# EasyEDA Pro project BlueberryPi.eprj, board PCB1 (continued)
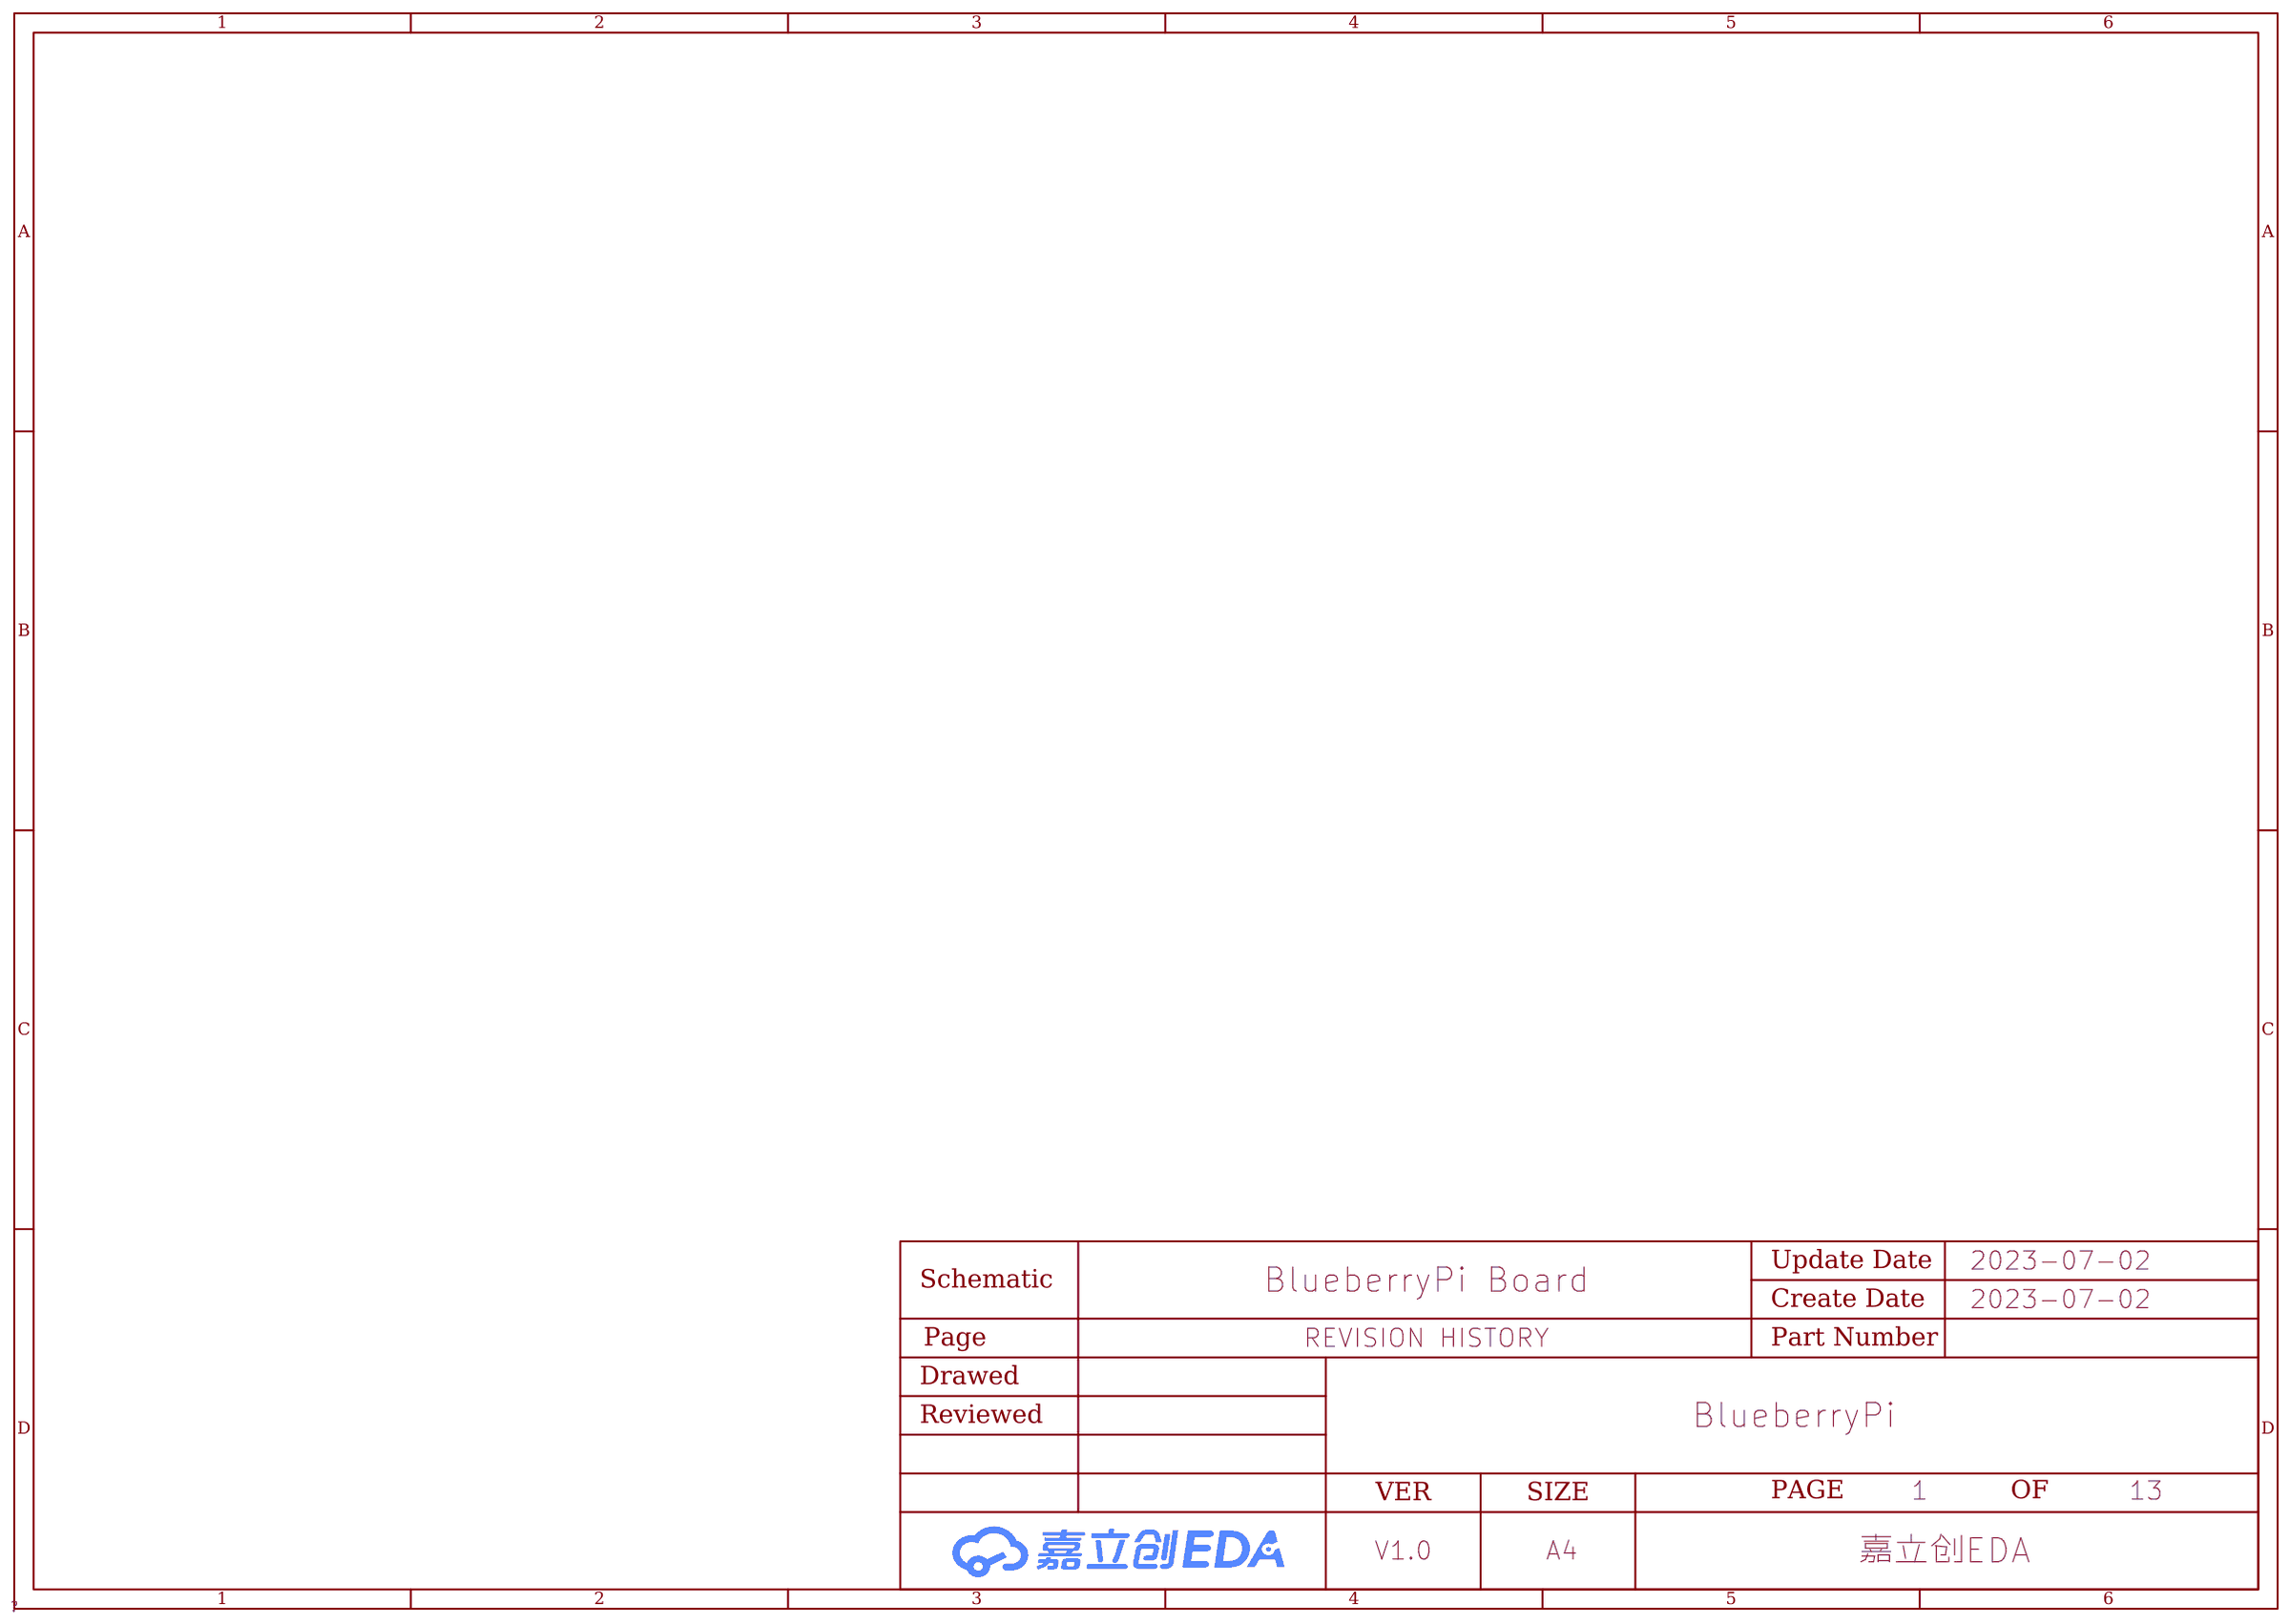
[diagram p0: REVISION HISTORY]
## Routing (per net, layer and track width the routed paths; a pad name or vN(x,y) marks a point on that pad's centre or on a via; arc(x,y) is an arc through that point) (continued)
SCKP: length 36.5
  Top Layer w0.102: v2(49.81,41.58) 49.63,41.76 49.63,42.01 49.86,42.24 49.86,42.67 49.77,42.77 49.62,42.77 49.53,42.67 U1.AC12
  Bottom Layer w0.102: v2(49.81,41.58) 49.81,41.57 49.64,41.4 49.64,40.52 arc(49.55,40.28) 49.31,40.19 49.11,40.19 arc(49.01,40.09) 49.11,39.98 49.31,39.98 arc(49.64,39.65) 49.31,39.32 49,39.32 arc(48.9,39.22) 49,39.12 49.31,39.12 arc(49.64,38.79) 49.31,38.46 49,38.46 arc(48.9,38.36) 49,38.26 49.31,38.26 arc(49.64,37.93) 49.31,37.6 49,37.6 arc(48.9,37.5) 49,37.39 49.31,37.39 arc(49.64,37.06) 49.31,36.73 49,36.73 arc(48.9,36.63) 49,36.53 49.31,36.53 arc(49.64,36.2) 49.31,35.87 49,35.87 arc(48.89,35.77) 49,35.67 49.31,35.67 arc(49.64,35.34) 49.31,35.01 49,35.01 arc(48.9,34.9) 49,34.8 49.31,34.8 arc(49.64,34.47) 49.31,34.14 49,34.14 arc(48.9,34.04) 49,33.94 49.31,33.94 arc(49.64,33.61) 49.31,33.28 49,33.28 arc(48.9,33.18) 49,33.08 49.31,33.08 arc(49.55,32.98) 49.64,32.75 49.64,31.62 arc(49.55,31.38) 49.31,31.29 49.16,31.29 arc(49.06,31.19) 49.16,31.08 49.31,31.08 arc(49.64,30.75) 49.31,30.42 49.16,30.42 arc(49.06,30.32) 49.16,30.22 49.31,30.22 arc(49.64,29.89) 49.31,29.56 49.16,29.56 arc(49.06,29.46) 49.16,29.36 49.31,29.36 arc(49.55,29.26) 49.64,29.03 49.64,28.33 arc(49.55,28.09) 49.31,28 48.02,28 arc(47.92,27.9) 48.02,27.8 49.31,27.8 arc(49.64,27.46) 49.31,27.13 48.91,27.13 arc(48.81,27.03) 48.91,26.93 49.31,26.93 arc(49.55,26.83) 49.64,26.6 49.64,26.33 49.18,25.87 49.18,24.69 49.41,24.45 49.49,24.45 49.56,24.52 v2(49.56,24.74)
SCS0: length 36.7
  Bottom Layer w0.127: v2(50.18,44.98) 50.54,45.34 55.11,45.34 57.49,42.96 57.49,24.86 55.31,22.68 51.19,22.68 50.18,23.69 50.18,24.48 50.49,24.79 v2(50.8,24.79)
SCS1: length 36.6
  Bottom Layer w0.127: v2(50.83,44.33) 50.83,43.56 50.98,43.41 arc(51.01,43.32) 50.98,43.23 49.91,42.16 arc(49.91,41.98) 50.09,41.98 51.16,43.05 arc(51.34,43.05) 51.34,42.87 50.26,41.8 arc(50.26,41.62) 50.44,41.62 51.52,42.69 arc(51.7,42.69) 51.69,42.51 50.62,41.44 arc(50.62,41.26) 50.8,41.26 51.88,42.33 arc(51.96,42.37) 52.05,42.33 52.11,42.28 52.17,42.28 arc(52.26,42.24) 52.3,42.15 52.3,41.08 arc(52.43,40.96) 52.55,41.08 52.55,42.15 arc(52.59,42.24) 52.68,42.28 54.1,42.28 54.39,41.99 54.39,34.15 54.52,34.02 54.52,32.86 54.04,32.37 54.04,28.55 53.52,28.03 51.35,28.03 50.9,27.58 v2(50.9,25.54)
SDC0-CLK: length 7
  Top Layer w0.127: U45.2 18.14,84.7 19.56,83.28 R94.2 ; CARD1.5 17.72,84.7
SDC0-CMD: length 62.1
  Top Layer w0.127: 12.5,83.69 13.42,82.77 17.17,82.77 18.24,81.7 18.24,78.74 19.11,77.86 19.79,77.86 37.68,59.97 37.68,56.74 39.6,54.83 39.6,54.1 41.24,52.46 43.26,52.46 43.58,52.78 U1.G3 ; 12.5,83.69 12.5,79.91 13.08,79.32 ; 12.5,83.69 12.5,87.12 12.88,87.5 15.16,87.5 15.52,87.15 CARD1.3 U43.2
SDC0-D0: length 44.1
  Top Layer w0.127: U1.F3 43.53,53.43 43.19,53.77 41.8,53.77 40.93,54.64 40.93,55.33 38.91,57.35 38.91,60.71 21.15,78.47 21.15,81.99 20.45,82.69 20.45,84.59 20.33,84.7 U47.2 CARD1.7
SDC0-D1: length 42.3
  Top Layer w0.127: U1.E2 42.67,54.44 42.17,54.44 41.89,54.72 41.5,54.72 41.27,54.95 41.27,55.52 39.23,57.56 39.23,60.88 21.54,78.58 21.54,84.6 21.44,84.7 U40.2 CARD1.8
SDC0-D2: length 49.3
  Top Layer w0.127: CARD1.1 U41.2 13.73,84.7 13.87,84.57 13.87,83.79 14.52,83.15 17.45,83.15 18.59,82 18.59,78.87 19.29,78.17 19.95,78.17 37.99,60.13 37.99,56.9 39.93,54.95 39.93,54.25 41.4,52.78 U1.G2
SDC0-D3: length 47.2
  Top Layer w0.127: U1.F1 41.67,53.43 40.6,54.5 40.6,55.21 38.6,57.21 38.6,60.55 20.82,78.33 20.82,78.93 19.98,79.77 19.1,79.77 18.94,79.93 18.94,82.27 17.68,83.53 15.25,83.53 14.97,83.81 14.97,84.56 14.83,84.7 U42.2 CARD1.2
SDC0-DET: length 45.1
  Top Layer w0.127: CARD1.9 U49.2 22.34,84.7 22.63,84.42 22.63,79.83 22.12,79.32 22.12,78.48 39.55,61.05 39.55,57.75 42.22,55.08 46.45,55.08 46.75,55.38 U1.C8
SDQ0: length 16.9
  Top Layer w0.127: U35.P9 52.78,29.49 v2(53.11,29.16) ; U1.AB18 53.11,42.71 53.11,42.04 v2(53.29,41.86)
  Bottom Layer w0.127: v2(53.11,29.16) 53.44,29.49 53.44,33.6 53.72,33.88 53.72,37.07 arc(53.69,37.14) 53.62,37.17 arc(53.54,37.2) 53.51,37.27 53.51,37.32 arc(53.54,37.39) 53.62,37.42 arc(53.69,37.45) 53.72,37.53 53.72,37.57 arc(53.69,37.65) 53.62,37.68 arc(53.54,37.71) 53.51,37.78 53.51,37.83 arc(53.54,37.9) 53.62,37.93 arc(53.69,37.96) 53.72,38.04 53.72,38.08 arc(53.69,38.16) 53.62,38.19 arc(53.54,38.22) 53.51,38.29 53.51,38.34 arc(53.54,38.41) 53.62,38.44 arc(53.69,38.47) 53.72,38.54 53.72,38.59 arc(53.69,38.66) 53.62,38.69 arc(53.54,38.72) 53.51,38.8 53.51,38.84 arc(53.54,38.92) 53.62,38.95 arc(53.69,38.98) 53.72,39.05 53.72,39.1 arc(53.69,39.17) 53.62,39.2 arc(53.54,39.23) 53.51,39.31 53.51,39.35 arc(53.54,39.43) 53.62,39.46 arc(53.69,39.49) 53.72,39.56 53.72,39.61 arc(53.69,39.68) 53.62,39.71 arc(53.54,39.74) 53.51,39.81 53.51,39.86 arc(53.54,39.93) 53.62,39.96 arc(53.69,39.99) 53.72,40.07 53.72,40.11 arc(53.69,40.19) 53.62,40.22 arc(53.54,40.25) 53.51,40.32 53.51,40.37 arc(53.54,40.44) 53.62,40.47 arc(53.69,40.5) 53.72,40.58 53.72,40.62 arc(53.69,40.7) 53.62,40.73 arc(53.54,40.76) 53.51,40.83 53.51,40.88 arc(53.54,40.95) 53.62,40.98 arc(53.69,41.01) 53.72,41.08 53.72,41.43 v2(53.29,41.86)
SDQ1: length 16.7
  Top Layer w0.127: U1.AC17 52.78,41.63 v2(52.96,41.45)
  Bottom Layer w0.127: v2(51.48,28.74) 51.87,29.13 52.43,29.13 53.16,29.87 53.16,33.71 53.42,33.96 53.42,34.11 arc(53.38,34.2) 53.29,34.24 53.26,34.24 arc(53.14,34.36) 53.26,34.49 53.29,34.49 arc(53.42,34.62) 53.29,34.75 53.26,34.75 arc(53.14,34.87) 53.26,35 53.29,35 arc(53.42,35.13) 53.29,35.25 53.26,35.25 arc(53.14,35.38) 53.26,35.51 53.29,35.51 arc(53.42,35.63) 53.29,35.76 53.26,35.76 arc(53.14,35.89) 53.26,36.02 53.29,36.02 arc(53.42,36.14) 53.29,36.27 53.26,36.27 arc(53.14,36.4) 53.26,36.52 53.29,36.52 arc(53.38,36.56) 53.42,36.65 ; 53.42,36.65 53.42,36.88 53.26,37.03 53.26,41.15 v2(52.96,41.45)
SDQ2: length 16.7
  Top Layer w0.127: v2(52.73,40.18) 52.73,40.58 arc(52.77,40.66) 52.86,40.7 52.98,40.7 arc(53.11,40.83) 52.98,40.96 52.86,40.96 arc(52.77,40.99) 52.73,41.08 52.73,41.17 52.45,41.45 52.45,42.7 U1.AB17
  Bottom Layer w0.127: v2(52.73,40.18) 52.93,39.98 52.93,39.84 arc(52.9,39.75) 52.81,39.71 52.78,39.71 arc(52.65,39.58) 52.78,39.45 52.81,39.45 arc(52.93,39.33) 52.81,39.2 52.78,39.2 arc(52.65,39.07) 52.78,38.95 52.81,38.95 arc(52.93,38.82) 52.81,38.69 52.78,38.69 arc(52.65,38.56) 52.78,38.44 52.81,38.44 arc(52.93,38.31) 52.81,38.18 52.78,38.18 arc(52.65,38.06) 52.78,37.93 52.81,37.93 arc(52.93,37.8) 52.81,37.68 52.78,37.68 arc(52.65,37.55) 52.78,37.42 52.81,37.42 arc(52.9,37.38) 52.93,37.3 52.93,36.8 52.88,36.75 52.88,30.29 52.78,30.19 arc(52.74,30.1) 52.78,30.01 52.79,30 arc(52.79,29.82) 52.61,29.82 52.6,29.83 arc(52.51,29.86) 52.42,29.83 v2(52.13,29.54)
SDQ3: length 16.8
  Top Layer w0.127: v2(52.25,39.95) 52.25,40.31 52.4,40.46 52.4,40.97 52.13,41.24 U1.AC16
  Bottom Layer w0.127: v2(52.13,30.34) 52.41,30.34 52.58,30.51 52.58,32.88 52.45,33 52.38,33 arc(52.25,33.13) 52.38,33.26 52.45,33.26 arc(52.58,33.39) 52.45,33.51 52.38,33.51 arc(52.25,33.64) 52.38,33.77 52.45,33.77 arc(52.58,33.89) 52.45,34.02 52.38,34.02 arc(52.25,34.15) 52.38,34.27 52.45,34.27 arc(52.58,34.4) 52.45,34.53 52.38,34.53 arc(52.25,34.66) 52.38,34.78 52.45,34.78 arc(52.58,34.91) 52.45,35.04 52.38,35.04 arc(52.25,35.16) 52.38,35.29 52.45,35.29 arc(52.58,35.42) 52.45,35.54 52.38,35.54 arc(52.25,35.67) 52.38,35.8 52.45,35.8 arc(52.54,35.84) 52.58,35.92 52.58,36.48 arc(52.55,36.55) 52.48,36.58 arc(52.4,36.61) 52.38,36.68 52.38,36.73 arc(52.4,36.8) 52.48,36.83 arc(52.55,36.86) 52.58,36.93 52.58,37.19 52.4,37.36 52.4,37.47 arc(52.36,37.56) 52.27,37.6 52.26,37.6 arc(52.13,37.73) 52.26,37.85 52.27,37.85 arc(52.4,37.98) 52.27,38.11 52.26,38.11 arc(52.13,38.23) 52.26,38.36 52.27,38.36 arc(52.4,38.49) 52.27,38.62 52.26,38.62 arc(52.13,38.74) 52.26,38.87 52.27,38.87 arc(52.4,39) 52.27,39.12 52.26,39.12 arc(52.13,39.25) 52.26,39.38 52.27,39.38 arc(52.36,39.41) 52.4,39.5 52.4,39.8 v2(52.25,39.95)
SDQ4: length 16.9
  Top Layer w0.127: v2(52.2,36.17) 52.2,36.8 52.25,36.85 arc(52.29,36.94) 52.38,36.98 52.54,36.98 arc(52.67,37.1) 52.54,37.23 52.38,37.23 arc(52.25,37.36) 52.38,37.48 52.54,37.48 arc(52.67,37.61) 52.54,37.74 52.38,37.74 arc(52.25,37.87) 52.38,37.99 52.54,37.99 arc(52.67,38.12) 52.54,38.25 52.38,38.25 arc(52.25,38.37) 52.38,38.5 52.54,38.5 arc(52.67,38.63) 52.54,38.75 52.38,38.75 arc(52.29,38.79) 52.25,38.88 52.25,39.01 52.14,39.12 arc(52.1,39.21) 52.14,39.3 52.19,39.36 arc(52.19,39.54) 52.01,39.54 51.96,39.48 arc(51.87,39.45) 51.78,39.48 51.48,39.78 arc(51.45,39.87) 51.48,39.96 51.74,40.21 arc(51.74,40.39) 51.56,40.39 51.3,40.14 arc(51.21,40.1) 51.12,40.14 51.06,40.2 51.06,41.46 51.16,41.55 51.16,42.71 U1.AB15
  Bottom Layer w0.127: v2(52.2,36.17) 51.74,35.72 51.74,31.53 v2(52.13,31.14)
SDQ5: length 16.8
  Top Layer w0.127: v2(50.29,40.95) 50.5,41.15 50.5,42.7 U1.AB14
  Bottom Layer w0.127: v2(50.29,40.95) 49.96,40.61 49.96,40.44 arc(49.99,40.38) 50.05,40.35 arc(50.11,40.33) 50.14,40.26 50.14,40.19 arc(50.11,40.12) 50.05,40.1 arc(49.99,40.07) 49.96,40.01 49.96,39.93 arc(49.99,39.87) 50.05,39.84 arc(50.11,39.82) 50.14,39.76 50.14,39.68 arc(50.11,39.62) 50.05,39.59 arc(49.99,39.56) 49.96,39.5 49.96,30.43 arc(50,30.34) 50.09,30.3 50.36,30.3 arc(50.49,30.18) 50.36,30.05 50.09,30.05 arc(50,30.01) 49.96,29.92 49.96,29.71 50.52,29.15 51.09,29.15 v2(51.48,29.54)
SDQ6: length 16.8
  Top Layer w0.127: v2(51.33,39.24) 50.83,39.75 50.83,39.89 arc(50.79,39.98) 50.7,40.02 50.5,40.02 arc(50.37,40.15) 50.5,40.27 50.7,40.27 arc(50.79,40.31) 50.83,40.4 50.83,40.44 arc(50.8,40.52) 50.72,40.55 arc(50.65,40.58) 50.62,40.65 50.62,40.7 arc(50.65,40.77) 50.72,40.8 arc(50.8,40.83) 50.83,40.91 U1.AC14
  Bottom Layer w0.127: v2(51.33,39.24) 51.33,39 arc(51.37,38.91) 51.46,38.88 51.75,38.88 arc(51.88,38.75) 51.75,38.62 51.46,38.62 arc(51.33,38.5) 51.46,38.37 51.75,38.37 arc(51.88,38.24) 51.75,38.11 51.46,38.11 arc(51.33,37.99) 51.46,37.86 51.75,37.86 arc(51.88,37.73) 51.75,37.61 51.46,37.61 arc(51.33,37.48) 51.46,37.35 51.75,37.35 arc(51.88,37.23) 51.75,37.1 51.46,37.1 arc(51.37,37.06) 51.33,36.97 51.33,36.68 51.21,36.55 51.21,30.61 v2(51.48,30.34)
SDQ7: length 16.9
  Top Layer w0.127: v2(51.83,36.56) 51.83,36.92 arc(51.79,37.01) 51.7,37.05 51.35,37.05 arc(51.22,37.17) 51.35,37.3 51.7,37.3 arc(51.83,37.43) 51.7,37.56 51.35,37.56 arc(51.22,37.68) 51.35,37.81 51.7,37.81 arc(51.79,37.85) 51.83,37.94 51.83,38.11 51.61,38.33 arc(51.52,38.37) 51.43,38.33 51.36,38.26 arc(51.18,38.26) 51.18,38.44 51.25,38.51 arc(51.25,38.69) 51.07,38.69 51,38.62 arc(50.83,38.62) 50.83,38.8 50.89,38.87 arc(50.89,39.05) 50.71,39.05 50.65,38.98 arc(50.47,38.98) 50.47,39.16 50.53,39.23 arc(50.53,39.41) 50.35,39.41 50.29,39.34 arc(50.11,39.34) 50.11,39.52 50.18,39.59 arc(50.21,39.68) 50.18,39.77 49.81,40.13 49.81,41.02 50.18,41.39 U1.AC13 ; U35.M11 51.48,31.07 v2(51.64,30.91)
  Bottom Layer w0.127: v2(51.83,36.56) 51.49,36.22 51.49,31.06 v2(51.64,30.91)
SDQ8: length 22.8
  Top Layer w0.127: U35.R11 53.75,31.46 53.75,32.23 53.57,32.41 53.57,32.45 arc(53.53,32.54) 53.44,32.58 53.31,32.58 arc(53.19,32.7) 53.31,32.83 53.44,32.83 arc(53.57,32.96) 53.44,33.08 53.31,33.08 arc(53.19,33.21) 53.31,33.34 53.44,33.34 arc(53.57,33.46) 53.44,33.59 53.31,33.59 arc(53.19,33.72) 53.31,33.85 53.44,33.85 arc(53.57,33.97) 53.44,34.1 53.31,34.1 arc(53.19,34.23) 53.31,34.35 53.44,34.35 arc(53.57,34.48) 53.44,34.61 53.31,34.61 arc(53.19,34.73) 53.31,34.86 53.44,34.86 arc(53.57,34.99) 53.44,35.12 53.31,35.12 arc(53.19,35.24) 53.31,35.37 53.44,35.37 arc(53.57,35.5) 53.44,35.62 53.31,35.62 arc(53.19,35.75) 53.31,35.88 53.44,35.88 arc(53.57,36) 53.44,36.13 53.31,36.13 arc(53.19,36.26) 53.31,36.39 53.44,36.39 arc(53.57,36.51) 53.44,36.64 53.31,36.64 arc(53.19,36.77) 53.31,36.89 53.44,36.89 arc(53.57,37.02) 53.44,37.15 53.31,37.15 arc(53.19,37.27) 53.31,37.4 53.44,37.4 arc(53.57,37.53) 53.44,37.66 53.31,37.66 arc(53.19,37.78) 53.31,37.91 53.44,37.91 arc(53.57,38.04) 53.44,38.16 53.31,38.16 arc(53.19,38.29) 53.31,38.42 53.44,38.42 arc(53.57,38.54) 53.44,38.67 53.31,38.67 arc(53.19,38.8) 53.31,38.93 53.44,38.93 arc(53.57,39.05) 53.44,39.18 53.31,39.18 arc(53.19,39.31) 53.31,39.43 53.44,39.43 arc(53.57,39.56) 53.44,39.69 53.31,39.69 arc(53.19,39.81) 53.31,39.94 53.44,39.94 arc(53.57,40.07) 53.44,40.2 53.31,40.2 arc(53.19,40.32) 53.31,40.45 53.44,40.45 arc(53.53,40.49) 53.57,40.58 53.57,40.69 53.62,40.74 arc(53.65,40.83) 53.62,40.92 53.57,40.97 arc(53.57,41.15) 53.75,41.15 54.02,40.87 arc(54.2,40.87) 54.2,41.05 53.93,41.33 arc(53.93,41.51) 54.11,41.51 54.16,41.46 arc(54.25,41.42) 54.34,41.46 54.41,41.53 54.41,42.7 U1.AB19
SDQ9: length 22.8
  Top Layer w0.127: U35.T11 54.08,31.42 54.41,31.75 54.41,32.03 54.68,32.31 54.86,32.31 55.09,32.54 55.09,32.92 54.81,33.21 arc(54.78,33.27) 54.81,33.34 arc(54.83,33.4) 54.81,33.47 54.76,33.52 arc(54.69,33.54) 54.63,33.52 arc(54.56,33.49) 54.49,33.52 54.36,33.66 54.36,33.74 arc(54.32,33.83) 54.23,33.87 53.97,33.87 arc(53.85,33.99) 53.97,34.12 54.23,34.12 arc(54.36,34.25) 54.23,34.38 53.97,34.38 arc(53.85,34.5) 53.97,34.63 54.23,34.63 arc(54.36,34.76) 54.23,34.88 53.97,34.88 arc(53.85,35.01) 53.97,35.14 54.23,35.14 arc(54.36,35.26) 54.23,35.39 53.97,35.39 arc(53.85,35.52) 53.97,35.65 54.23,35.65 arc(54.36,35.77) 54.23,35.9 53.97,35.9 arc(53.85,36.03) 53.97,36.15 54.23,36.15 arc(54.36,36.28) 54.23,36.41 53.97,36.41 arc(53.85,36.53) 53.97,36.66 54.23,36.66 arc(54.36,36.79) 54.23,36.92 53.97,36.92 arc(53.85,37.04) 53.97,37.17 54.23,37.17 arc(54.36,37.3) 54.23,37.42 53.97,37.42 arc(53.85,37.55) 53.97,37.68 54.23,37.68 arc(54.36,37.8) 54.23,37.93 53.97,37.93 arc(53.85,38.06) 53.97,38.19 54.23,38.19 arc(54.36,38.31) 54.23,38.44 53.97,38.44 arc(53.85,38.57) 53.97,38.69 54.23,38.69 arc(54.36,38.82) 54.23,38.95 53.97,38.95 arc(53.85,39.07) 53.97,39.2 54.23,39.2 arc(54.36,39.33) 54.23,39.46 53.97,39.46 arc(53.85,39.58) 53.97,39.71 54.23,39.71 arc(54.36,39.84) 54.23,39.96 53.97,39.96 arc(53.85,40.09) 53.97,40.22 54.23,40.22 arc(54.32,40.25) 54.36,40.34 54.36,40.49 54.73,40.86 U1.AC20
SDQ10: length 22.9
  Top Layer w0.127: U35.T10 54.11,30.34 54.6,30.84 54.93,30.84 55.8,31.71 55.8,31.81 arc(55.84,31.89) 55.92,31.93 arc(56.01,31.96) 56.04,32.05 56.04,32.06 arc(56.01,32.15) 55.92,32.18 55.69,32.18 arc(55.61,32.21) 55.57,32.3 55.57,32.32 arc(55.61,32.4) 55.69,32.44 56.01,32.44 arc(56.13,32.56) 56.01,32.69 55.93,32.69 arc(55.84,32.73) 55.8,32.82 55.8,33.31 55.68,33.43 55.55,33.43 arc(55.42,33.56) 55.55,33.69 55.68,33.69 arc(55.8,33.81) 55.68,33.94 55.55,33.94 arc(55.42,34.07) 55.55,34.19 55.68,34.19 arc(55.8,34.32) 55.68,34.45 55.55,34.45 arc(55.42,34.58) 55.55,34.7 55.68,34.7 arc(55.8,34.83) 55.68,34.96 55.55,34.96 arc(55.42,35.08) 55.55,35.21 55.68,35.21 arc(55.8,35.34) 55.68,35.46 55.55,35.46 arc(55.42,35.59) 55.55,35.72 55.68,35.72 arc(55.8,35.84) 55.68,35.97 55.55,35.97 arc(55.42,36.1) 55.55,36.23 55.68,36.23 arc(55.8,36.35) 55.68,36.48 55.55,36.48 arc(55.42,36.61) 55.55,36.73 55.68,36.73 arc(55.8,36.86) 55.68,36.99 55.55,36.99 arc(55.42,37.12) 55.55,37.24 55.68,37.24 arc(55.8,37.37) 55.68,37.5 55.55,37.5 arc(55.42,37.62) 55.55,37.75 55.68,37.75 arc(55.8,37.88) 55.68,38 55.55,38 arc(55.42,38.13) 55.55,38.26 55.68,38.26 arc(55.8,38.39) 55.68,38.51 55.55,38.51 arc(55.42,38.64) 55.55,38.77 55.68,38.77 arc(55.8,38.89) 55.68,39.02 55.55,39.02 arc(55.42,39.15) 55.55,39.27 55.68,39.27 arc(55.8,39.4) 55.68,39.53 55.55,39.53 arc(55.42,39.66) 55.55,39.78 55.68,39.78 arc(55.8,39.91) 55.68,40.04 55.55,40.04 arc(55.42,40.16) 55.55,40.29 55.68,40.29 arc(55.77,40.33) 55.8,40.42 55.8,40.46 arc(55.84,40.55) 55.93,40.59 56.03,40.59 arc(56.16,40.71) 56.03,40.84 55.93,40.84 arc(55.8,40.97) 55.93,41.09 56.03,41.09 arc(56.16,41.22) 56.03,41.35 55.93,41.35 arc(55.84,41.39) 55.8,41.48 55.8,41.55 55.38,41.98 U1.AC21
SDQ11: length 23
  Top Layer w0.127: U35.R10 53.56,30.34 54.05,30.84 54.28,30.84 54.38,30.94 54.38,31.34 54.64,31.61 55,31.61 55.35,31.95 55.35,33.21 55.07,33.49 55.07,33.83 arc(55.03,33.91) 54.94,33.95 54.79,33.95 arc(54.66,34.08) 54.79,34.21 54.94,34.21 arc(55.07,34.33) 54.94,34.46 54.79,34.46 arc(54.66,34.59) 54.79,34.71 54.94,34.71 arc(55.07,34.84) 54.94,34.97 54.76,34.97 arc(54.64,35.09) 54.76,35.22 54.94,35.22 arc(55.07,35.35) 54.94,35.48 54.76,35.48 arc(54.64,35.6) 54.76,35.73 54.94,35.73 arc(55.07,35.86) 54.94,35.98 54.76,35.98 arc(54.64,36.11) 54.76,36.24 54.94,36.24 arc(55.07,36.37) 54.94,36.49 54.76,36.49 arc(54.64,36.62) 54.76,36.75 54.94,36.75 arc(55.07,36.87) 54.94,37 54.76,37 arc(54.64,37.13) 54.76,37.25 54.94,37.25 arc(55.07,37.38) 54.94,37.51 54.76,37.51 arc(54.64,37.64) 54.76,37.76 54.94,37.76 arc(55.07,37.89) 54.94,38.02 54.76,38.02 arc(54.64,38.14) 54.76,38.27 54.94,38.27 arc(55.07,38.4) 54.94,38.52 54.76,38.52 arc(54.64,38.65) 54.76,38.78 54.94,38.78 arc(55.07,38.91) 54.94,39.03 54.76,39.03 arc(54.64,39.16) 54.76,39.29 54.94,39.29 arc(55.07,39.41) 54.94,39.54 54.76,39.54 arc(54.64,39.67) 54.76,39.79 54.94,39.79 arc(55.07,39.92) 54.94,40.05 54.76,40.05 arc(54.64,40.17) 54.76,40.3 54.94,40.3 arc(55.03,40.34) 55.07,40.43 55.07,40.57 arc(55.1,40.65) 55.18,40.69 arc(55.26,40.72) 55.3,40.8 55.3,40.83 arc(55.26,40.91) 55.18,40.94 arc(55.1,40.97) 55.07,41.05 55.07,41.08 arc(55.1,41.16) 55.18,41.19 arc(55.26,41.23) 55.3,41.31 55.3,41.33 arc(55.26,41.41) 55.18,41.45 arc(55.1,41.48) 55.07,41.56 55.07,42.69 U1.AB20
SDQ12: length 23
  Top Layer w0.127: U35.T9 54.08,29.49 54.43,29.13 55.45,29.13 55.65,29.34 55.65,29.77 55.88,30 arc(55.92,30.09) 55.88,30.18 55.83,30.23 arc(55.83,30.41) 56.01,30.41 56.06,30.36 arc(56.24,30.36) 56.24,30.54 56.19,30.59 arc(56.19,30.77) 56.37,30.77 56.42,30.72 arc(56.6,30.72) 56.6,30.9 56.55,30.94 arc(56.55,31.12) 56.73,31.12 56.78,31.08 arc(56.96,31.08) 56.96,31.25 56.91,31.3 arc(56.91,31.48) 57.09,31.48 57.14,31.43 arc(57.23,31.4) 57.32,31.43 57.38,31.5 57.38,31.71 arc(57.35,31.78) 57.28,31.81 arc(57.21,31.84) 57.18,31.91 57.18,31.96 arc(57.21,32.03) 57.28,32.06 arc(57.35,32.09) 57.38,32.16 57.38,32.21 arc(57.35,32.28) 57.28,32.31 arc(57.21,32.34) 57.18,32.41 57.18,32.47 arc(57.21,32.54) 57.28,32.57 arc(57.35,32.6) 57.38,32.67 57.38,32.72 arc(57.35,32.79) 57.28,32.82 arc(57.21,32.85) 57.18,32.92 57.18,32.98 arc(57.21,33.05) 57.28,33.08 arc(57.35,33.11) 57.38,33.18 57.38,33.23 arc(57.35,33.3) 57.28,33.33 arc(57.21,33.36) 57.18,33.43 57.18,33.48 arc(57.21,33.55) 57.28,33.58 arc(57.35,33.61) 57.38,33.68 57.38,33.74 arc(57.35,33.81) 57.28,33.84 arc(57.21,33.87) 57.18,33.94 57.18,33.99 arc(57.21,34.06) 57.28,34.09 arc(57.35,34.12) 57.38,34.19 57.38,34.25 arc(57.35,34.32) 57.28,34.35 arc(57.21,34.38) 57.18,34.45 57.18,34.5 arc(57.21,34.57) 57.28,34.6 arc(57.35,34.63) 57.38,34.7 57.38,34.75 arc(57.35,34.82) 57.28,34.85 arc(57.21,34.88) 57.18,34.95 57.18,35.01 arc(57.21,35.08) 57.28,35.11 arc(57.35,35.14) 57.38,35.21 57.38,35.26 arc(57.35,35.33) 57.28,35.36 arc(57.21,35.39) 57.18,35.46 57.18,35.52 arc(57.21,35.59) 57.28,35.62 arc(57.35,35.65) 57.38,35.72 57.38,35.77 arc(57.35,35.84) 57.28,35.87 arc(57.21,35.9) 57.18,35.97 57.18,36.02 arc(57.21,36.09) 57.28,36.12 arc(57.35,36.15) 57.38,36.22 57.38,36.28 arc(57.35,36.35) 57.28,36.38 arc(57.21,36.41) 57.18,36.48 57.18,36.53 arc(57.21,36.6) 57.28,36.63 arc(57.35,36.66) 57.38,36.73 57.38,36.79 arc(57.35,36.86) 57.28,36.89 arc(57.21,36.92) 57.18,36.99 57.18,37.04 arc(57.21,37.11) 57.28,37.14 arc(57.35,37.17) 57.38,37.24 57.38,37.29 arc(57.35,37.36) 57.28,37.39 arc(57.21,37.42) 57.18,37.49 57.18,37.55 arc(57.21,37.62) 57.28,37.65 arc(57.35,37.68) 57.38,37.75 57.38,37.8 arc(57.35,37.87) 57.28,37.9 arc(57.21,37.93) 57.18,38 57.18,38.06 arc(57.21,38.13) 57.28,38.16 arc(57.35,38.19) 57.38,38.26 57.38,38.31 arc(57.35,38.38) 57.28,38.41 arc(57.21,38.44) 57.18,38.51 57.18,38.56 arc(57.21,38.63) 57.28,38.66 arc(57.35,38.69) 57.38,38.76 57.38,38.82 arc(57.35,38.89) 57.28,38.92 arc(57.21,38.95) 57.18,39.02 57.18,39.07 arc(57.21,39.14) 57.28,39.17 arc(57.35,39.2) 57.38,39.27 57.38,39.33 arc(57.35,39.4) 57.28,39.43 arc(57.21,39.46) 57.18,39.53 57.18,39.58 arc(57.21,39.65) 57.28,39.68 arc(57.35,39.71) 57.38,39.78 57.38,39.83 arc(57.35,39.9) 57.28,39.93 arc(57.21,39.96) 57.18,40.03 57.18,40.09 arc(57.21,40.16) 57.28,40.19 arc(57.35,40.22) 57.38,40.29 57.38,40.34 arc(57.35,40.41) 57.28,40.44 arc(57.21,40.47) 57.18,40.54 57.18,40.6 arc(57.21,40.67) 57.28,40.7 arc(57.35,40.73) 57.38,40.8 57.38,40.85 arc(57.35,40.92) 57.28,40.95 arc(57.21,40.98) 57.18,41.05 57.18,41.1 arc(57.21,41.17) 57.28,41.2 arc(57.35,41.23) 57.38,41.3 57.38,41.36 arc(57.35,41.43) 57.28,41.46 arc(57.21,41.49) 57.18,41.56 57.18,41.61 arc(57.21,41.68) 57.28,41.71 arc(57.35,41.74) 57.38,41.81 57.38,42.57 56.92,43.03 U1.AB23
SDQ13: length 22.9
  Top Layer w0.127: U1.AA23 57.16,43.68 57.89,42.96 57.89,29.9 57.74,29.74 arc(57.65,29.71) 57.56,29.74 57.47,29.83 arc(57.29,29.83) 57.29,29.65 57.38,29.56 arc(57.38,29.38) 57.2,29.38 57.11,29.47 arc(56.93,29.47) 56.93,29.29 57.02,29.21 arc(57.02,29.03) 56.84,29.03 56.75,29.11 arc(56.57,29.11) 56.57,28.93 56.66,28.85 arc(56.66,28.67) 56.48,28.67 56.39,28.75 arc(56.21,28.75) 56.21,28.57 56.3,28.49 arc(56.34,28.4) 56.3,28.31 56.08,28.09 54.25,28.09 53.75,28.6 53.75,29.22 U35.R9
SDQ14: length 22.9
  Top Layer w0.127: U35.T8 54.45,28.37 55.06,28.37 arc(55.15,28.41) 55.19,28.5 55.19,28.68 arc(55.32,28.8) 55.45,28.68 55.45,28.5 arc(55.48,28.41) 55.57,28.37 55.68,28.37 55.85,28.55 55.85,28.85 56.16,29.16 arc(56.19,29.25) 56.16,29.34 55.97,29.53 arc(55.97,29.7) 56.15,29.71 56.34,29.52 arc(56.52,29.52) 56.52,29.7 56.33,29.88 arc(56.33,30.06) 56.51,30.06 56.7,29.88 arc(56.88,29.88) 56.88,30.06 56.69,30.24 arc(56.69,30.42) 56.87,30.42 57.06,30.23 arc(57.23,30.23) 57.24,30.41 57.05,30.6 arc(57.05,30.78) 57.23,30.78 57.41,30.59 arc(57.5,30.56) 57.59,30.59 57.63,30.63 57.63,42.77 57.02,43.38 56.33,43.38 U1.AA22
SDQ15: length 22.8
  Top Layer w0.127: U1.Y22 56.34,44.02 57.25,44.02 58.14,43.13 58.14,29.67 58.06,29.59 arc(58.04,29.58) 58.02,29.59 arc(58,29.59) 57.98,29.59 57.84,29.45 arc(57.83,29.43) 57.84,29.41 57.88,29.37 arc(57.89,29.35) 57.88,29.33 57.74,29.19 arc(57.72,29.18) 57.7,29.19 57.66,29.23 arc(57.64,29.24) 57.62,29.23 57.48,29.09 arc(57.48,29.07) 57.48,29.05 57.52,29.01 arc(57.53,28.99) 57.52,28.97 57.38,28.83 arc(57.36,28.82) 57.34,28.83 57.3,28.87 arc(57.28,28.88) 57.27,28.87 57.12,28.73 arc(57.12,28.71) 57.12,28.69 57.16,28.65 arc(57.17,28.63) 57.16,28.61 57.02,28.47 arc(57,28.46) 56.98,28.47 56.94,28.51 arc(56.93,28.52) 56.91,28.51 56.76,28.37 arc(56.76,28.35) 56.76,28.33 56.8,28.29 arc(56.81,28.27) 56.8,28.25 56.66,28.11 arc(56.64,28.1) 56.62,28.11 56.59,28.15 arc(56.57,28.16) 56.55,28.15 56.41,28.01 arc(56.4,27.99) 56.41,27.97 arc(56.41,27.95) 56.41,27.93 56.29,27.81 54.05,27.81 53.43,28.44 U35.R8
SDQ16: length 17.7
  Top Layer w0.127: v2(46,39.37) 45.82,39.55 45.82,41.87 45.63,42.06 45.63,42.38
  Bottom Layer w0.127: v2(46,39.37) 46.16,39.2 46.16,38.8 45.47,38.11 45.47,33.36 45.34,33.23 45.34,33.09 arc(45.3,33) 45.21,32.96 44.97,32.96 arc(44.85,32.83) 44.97,32.71 45.21,32.71 arc(45.3,32.67) 45.34,32.58 45.34,32.44 45.47,32.32 45.47,30.45 arc(45.5,30.36) 45.59,30.32 45.67,30.32 arc(45.8,30.19) 45.67,30.07 45.59,30.07 arc(45.47,29.94) 45.59,29.81 45.67,29.81 arc(45.8,29.69) 45.67,29.56 45.59,29.56 arc(45.5,29.52) 45.47,29.43 45.47,29.08 45.79,28.75 46.43,28.75 46.95,29.28 v2(46.95,29.54)
SDQ17: length 17.9
  Top Layer w0.127: v2(45.75,38.9) 45.58,39.06 45.58,41.78 45.3,42.06 45.3,42.46 45.63,42.79 U1.AB6
  Bottom Layer w0.127: v2(47.58,28.74) 47.22,28.38 45.73,28.38 45.05,29.06 45.05,31.52 44.62,31.95 44.62,33.29 44.87,33.54 44.87,38.02 v2(45.75,38.9)
SDQ18: length 17.6
  Top Layer w0.127: v2(46.55,40.3) 46.28,40.56 U1.AC7
  Bottom Layer w0.127: v2(47.58,29.54) 47.16,29.96 46.61,29.96 46.32,30.25 46.32,30.38 45.92,30.77 45.92,31.53 46.06,31.67 46.06,32.3 46.34,32.57 46.34,33.06 46.05,33.35 46.05,33.88 arc(46.09,33.97) 46.18,34.01 46.28,34.01 arc(46.41,34.14) 46.28,34.27 46.18,34.27 arc(46.05,34.39) 46.18,34.52 46.28,34.52 arc(46.41,34.65) 46.28,34.77 46.18,34.77 arc(46.05,34.9) 46.18,35.03 46.28,35.03 arc(46.41,35.15) 46.28,35.28 46.18,35.28 arc(46.09,35.32) 46.05,35.41 46.05,35.61 46.16,35.72 arc(46.25,35.76) 46.34,35.72 46.37,35.69 arc(46.55,35.69) 46.55,35.87 46.52,35.9 arc(46.48,35.99) 46.52,36.08 46.65,36.21 46.65,36.46 arc(46.61,36.55) 46.52,36.59 46.46,36.59 arc(46.33,36.71) 46.46,36.84 46.52,36.84 arc(46.65,36.97) 46.52,37.09 46.46,37.09 arc(46.33,37.22) 46.46,37.35 46.52,37.35 arc(46.65,37.47) 46.52,37.6 46.46,37.6 arc(46.33,37.73) 46.46,37.86 46.52,37.86 arc(46.61,37.89) 46.65,37.98 46.65,40.2 v2(46.55,40.3)
SDQ19: length 17.6
  Top Layer w0.127: U1.AB7 45.97,42.72 45.97,42.04 46.05,41.97 46.05,40.04 v2(46.22,39.88)
  Top Layer w0.254: U35.D9 46.28,29.47 v2(45.96,29.15)
  Bottom Layer w0.127: v2(45.96,29.15) 46.09,29.27 46.09,29.35 arc(46.13,29.44) 46.22,29.48 46.29,29.48 arc(46.42,29.61) 46.29,29.74 46.22,29.74 arc(46.13,29.77) 46.09,29.86 46.09,30.28 45.69,30.67 45.69,31.62 45.83,31.76 45.83,32.39 46.11,32.67 46.11,32.97 45.82,33.26 45.82,35.97 arc(45.86,36.05) 45.95,36.09 45.97,36.09 arc(46.1,36.22) 45.97,36.35 45.95,36.35 arc(45.82,36.47) 45.95,36.6 45.97,36.6 arc(46.1,36.73) 45.97,36.85 45.95,36.85 arc(45.82,36.98) 45.95,37.11 45.97,37.11 arc(46.1,37.23) 45.97,37.36 45.95,37.36 arc(45.82,37.49) 45.95,37.62 45.97,37.62 arc(46.1,37.74) 45.97,37.87 45.95,37.87 arc(45.86,37.91) 45.82,38 45.82,38.14 45.94,38.26 arc(46.03,38.29) 46.12,38.26 46.15,38.23 arc(46.33,38.23) 46.33,38.41 46.3,38.44 arc(46.26,38.53) 46.3,38.62 46.39,38.71 46.39,39.7 v2(46.22,39.88)
SDQ20: length 17.6
  Top Layer w0.127: U1.AC9 47.58,41.66 47.88,41.36 47.88,40.32 46.42,38.86 46.42,38.66 arc(46.46,38.57) 46.55,38.53 46.67,38.53 arc(46.8,38.4) 46.67,38.28 46.55,38.28 arc(46.42,38.15) 46.55,38.02 46.67,38.02 arc(46.8,37.9) 46.67,37.77 46.55,37.77 arc(46.42,37.64) 46.55,37.51 46.67,37.51 arc(46.8,37.39) 46.67,37.26 46.55,37.26 arc(46.42,37.13) 46.55,37.01 46.67,37.01 arc(46.8,36.88) 46.67,36.75 46.55,36.75 arc(46.42,36.63) 46.55,36.5 46.67,36.5 arc(46.8,36.37) 46.67,36.24 46.55,36.24 arc(46.42,36.12) 46.55,35.99 46.67,35.99 arc(46.8,35.86) 46.67,35.74 46.55,35.74 arc(46.46,35.7) 46.42,35.61 46.42,35.59 arc(46.45,35.51) 46.54,35.47 arc(46.62,35.44) 46.66,35.36 46.66,35.34 arc(46.62,35.25) 46.54,35.22 arc(46.45,35.19) 46.42,35.1 46.42,34.66 v2(46.84,34.24)